# Altium schematic sheet fpga-tx.SchDoc
size D; CompanyName: Brinton Engineering, LLC; Address1: 3479 Edison Way; Address2: Menlo Park CA 94025; Address3: +1 (877) 778-8435; Address4: brintonengineering.com; DocumentNumber: 42; Revision: 1; SheetNumber: 42; SheetTotal: 50
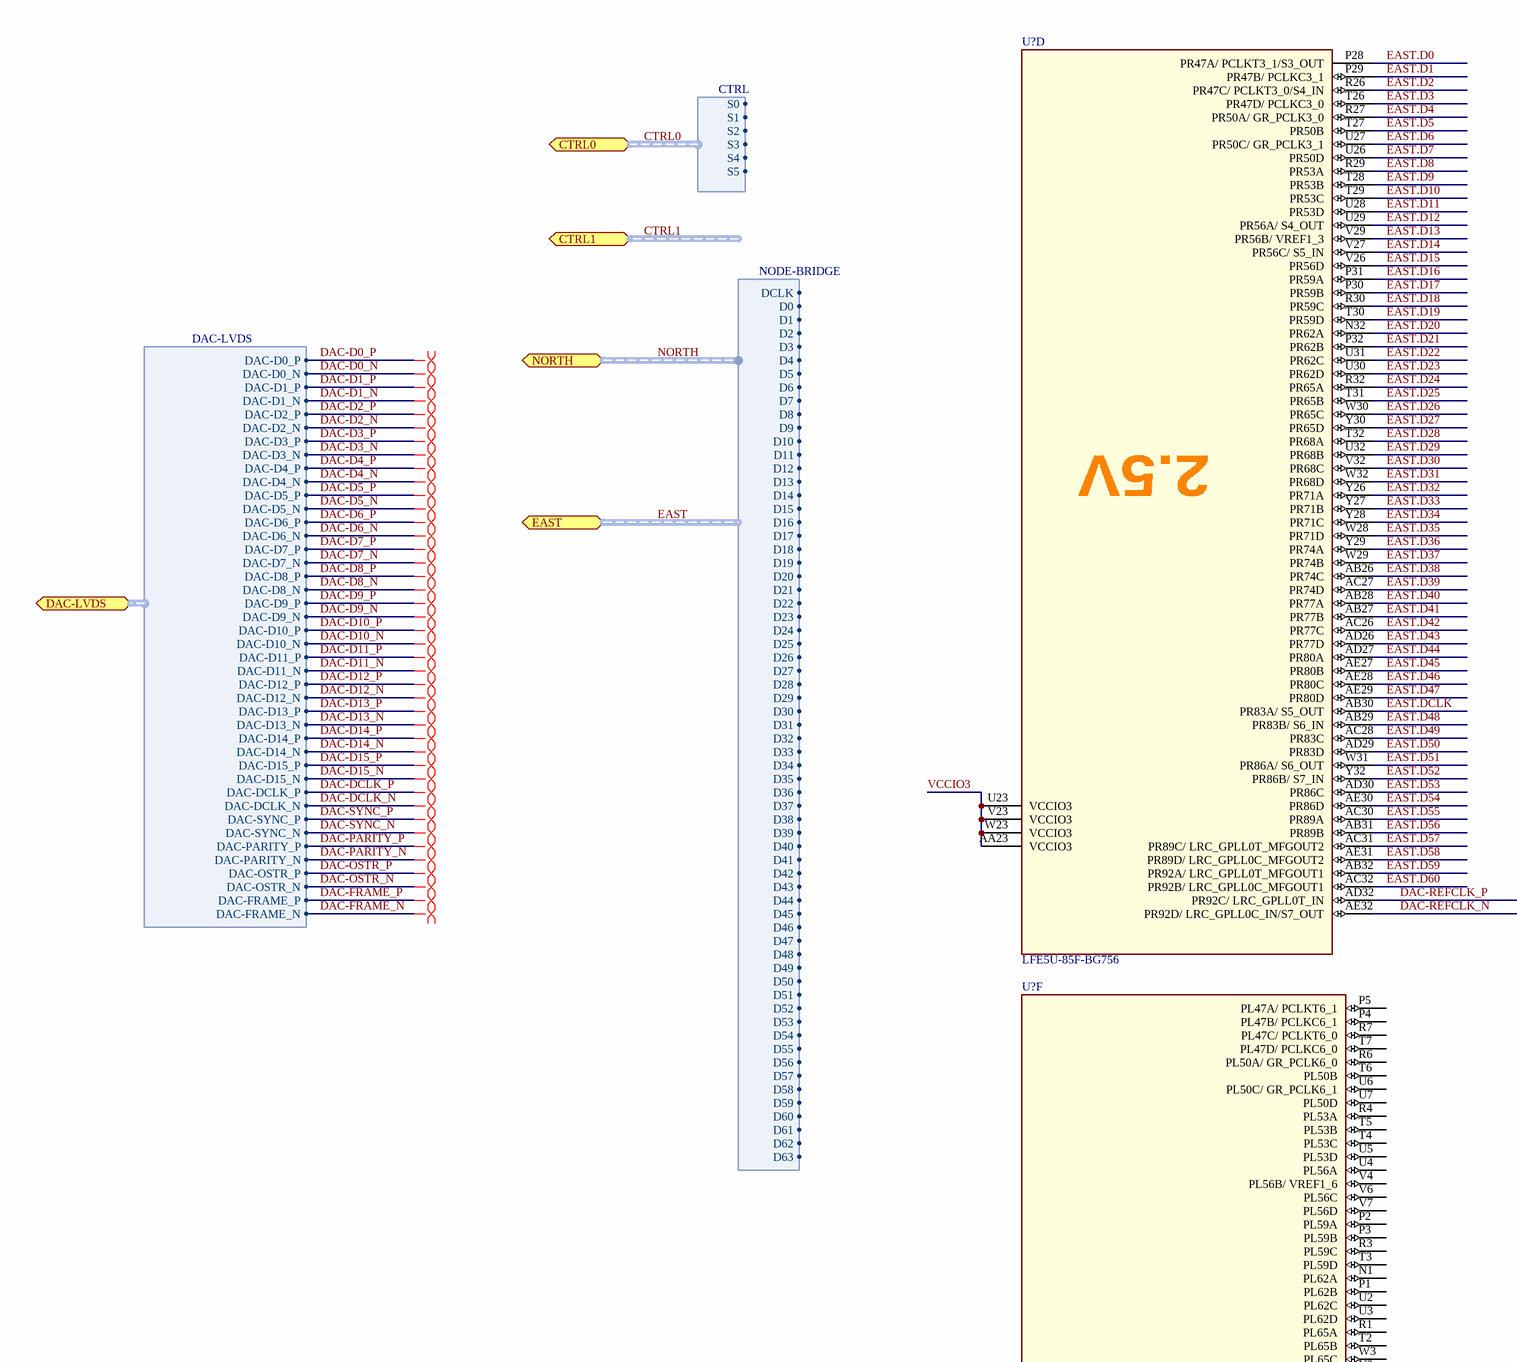
[diagram p0: fpga-tx.SchDoc, top left]
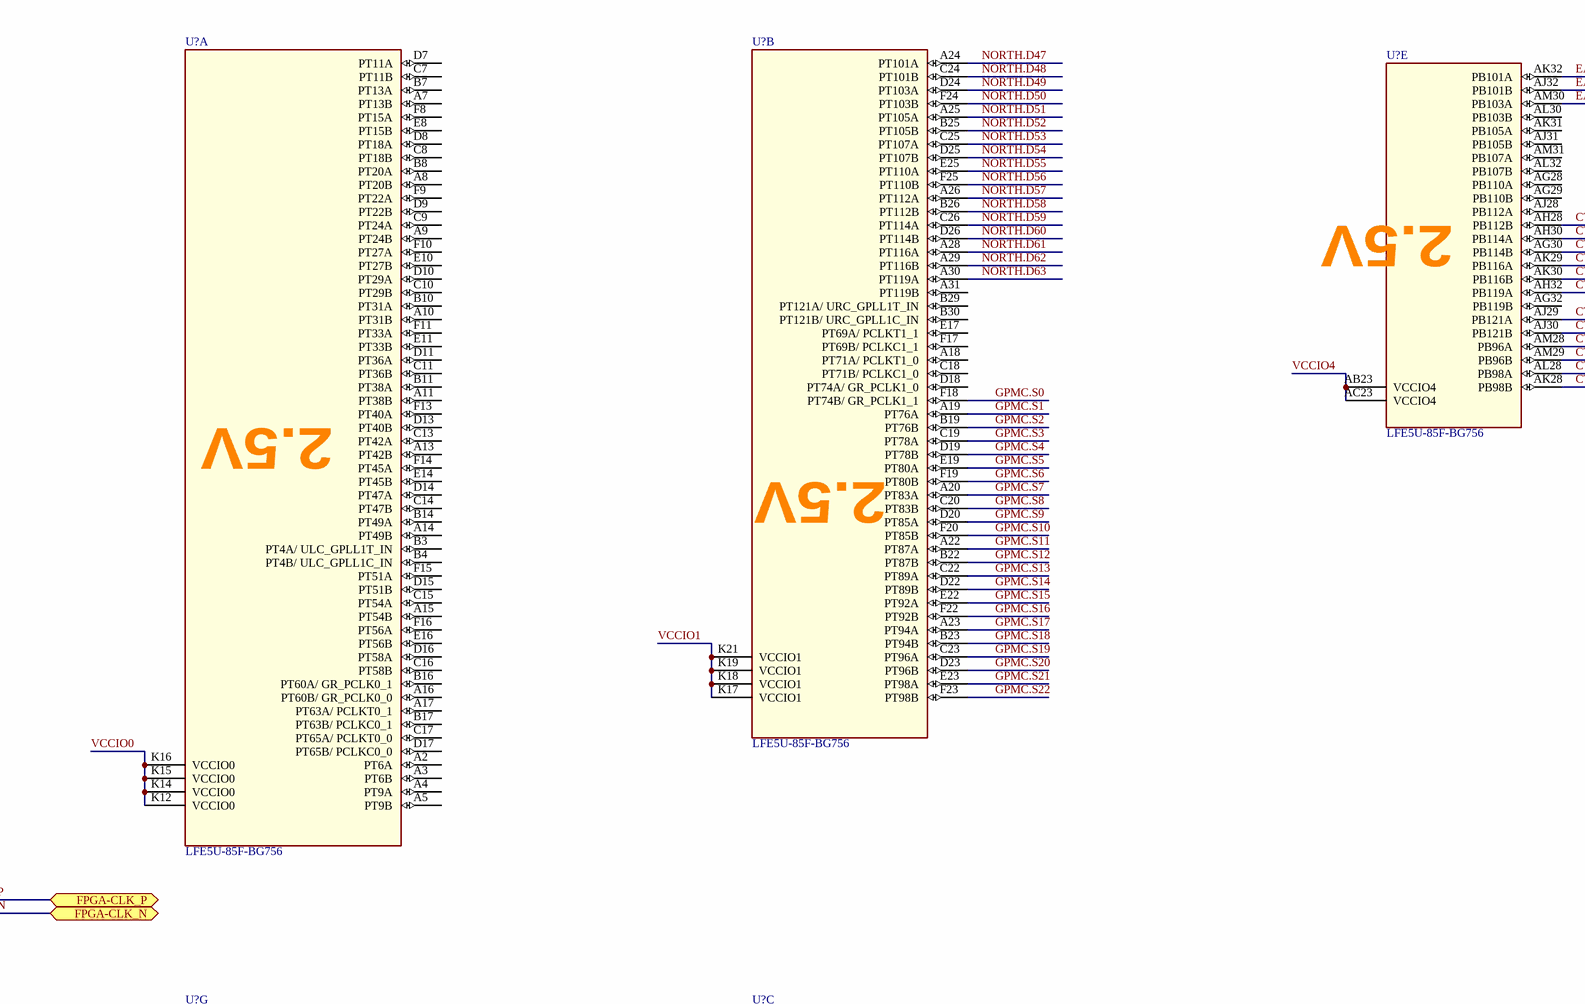
[diagram p1: fpga-tx.SchDoc, top middle]
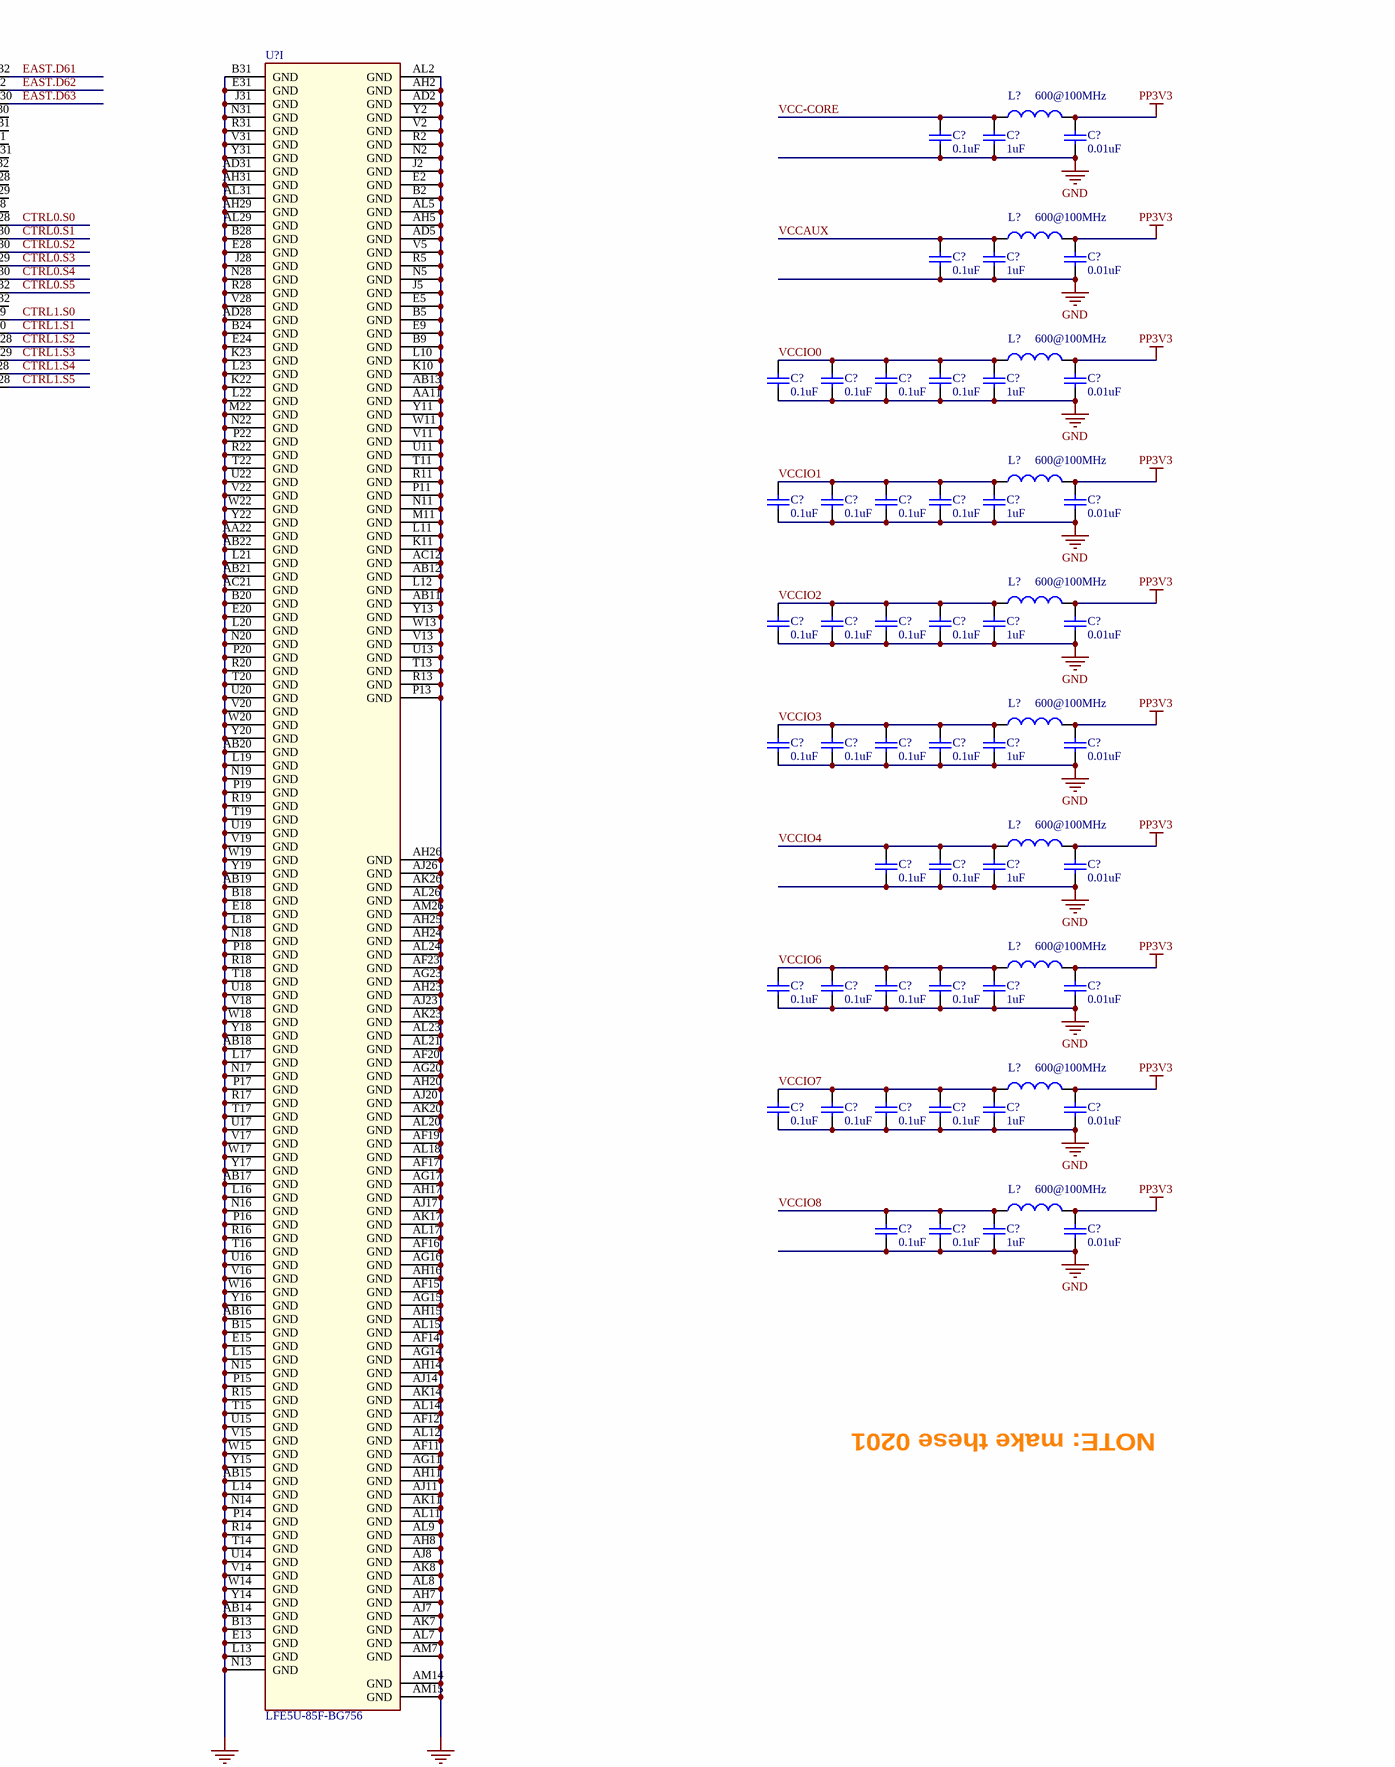
[diagram p2: fpga-tx.SchDoc, top right]
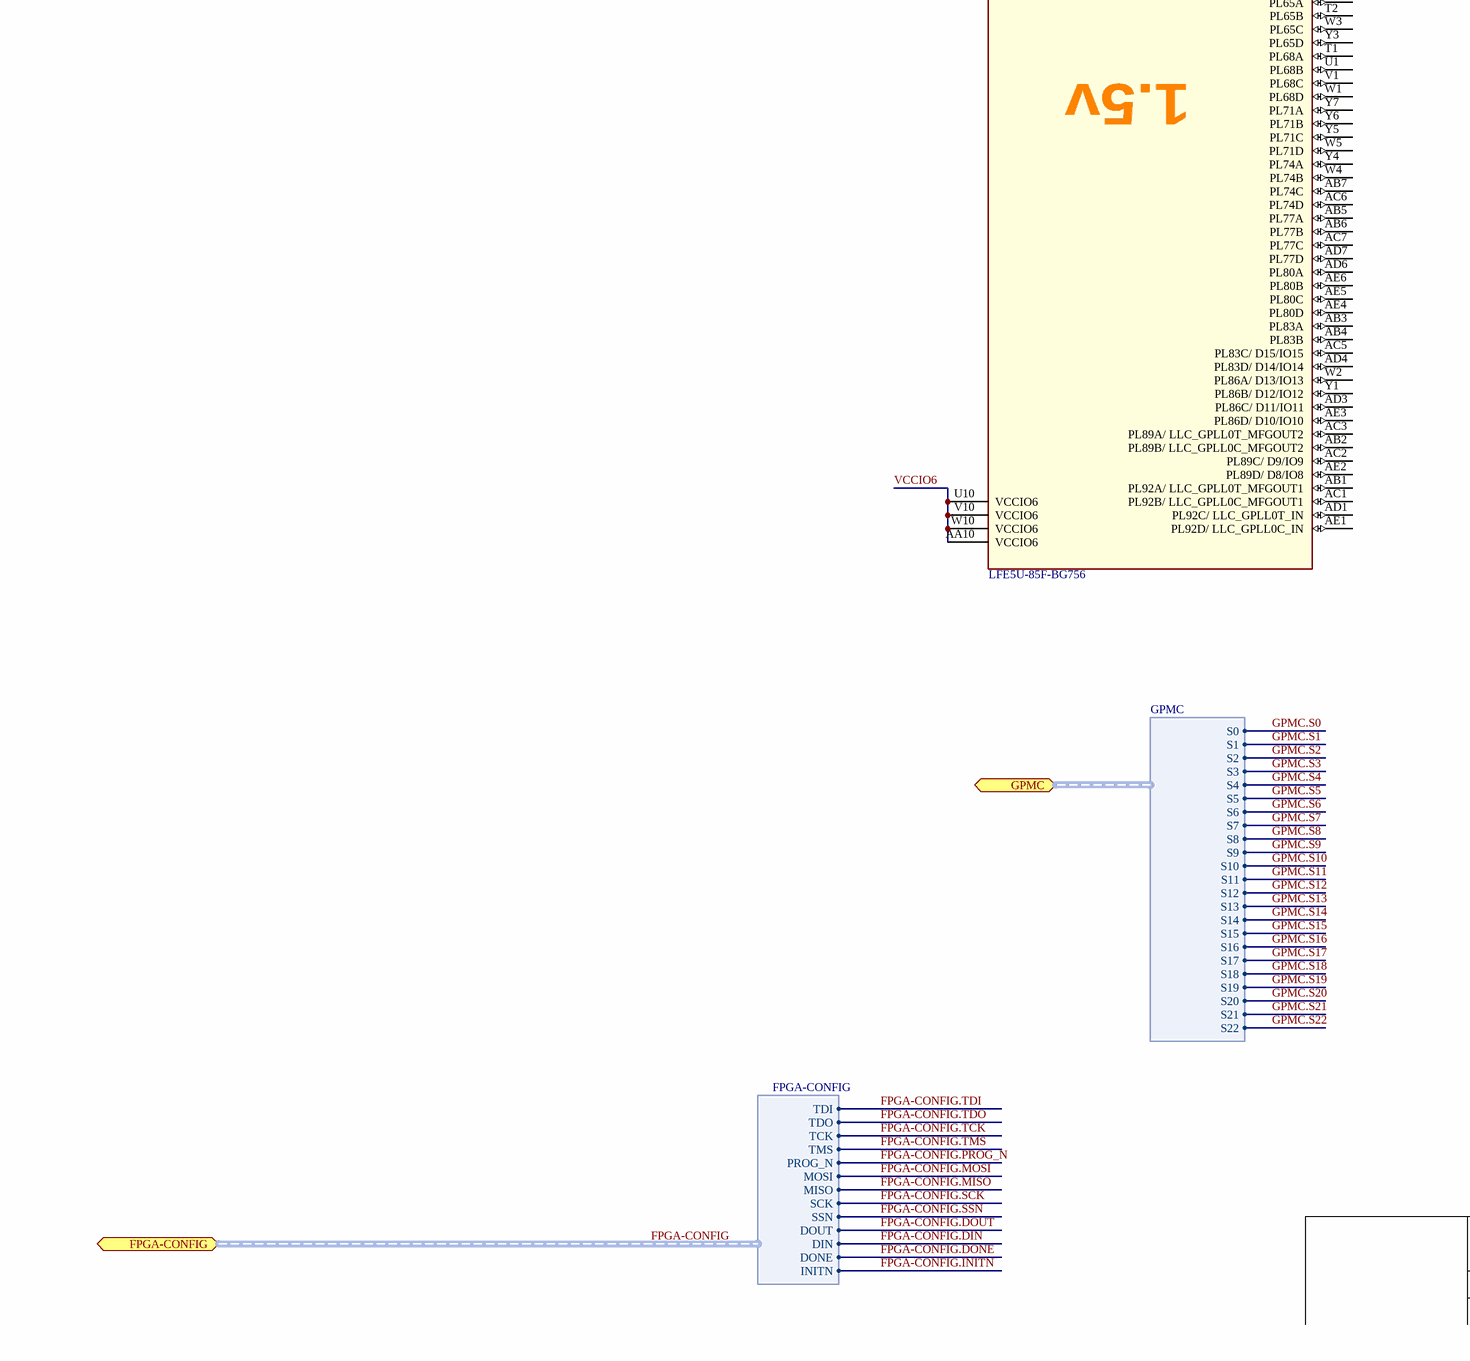
[diagram p3: fpga-tx.SchDoc, bottom left]
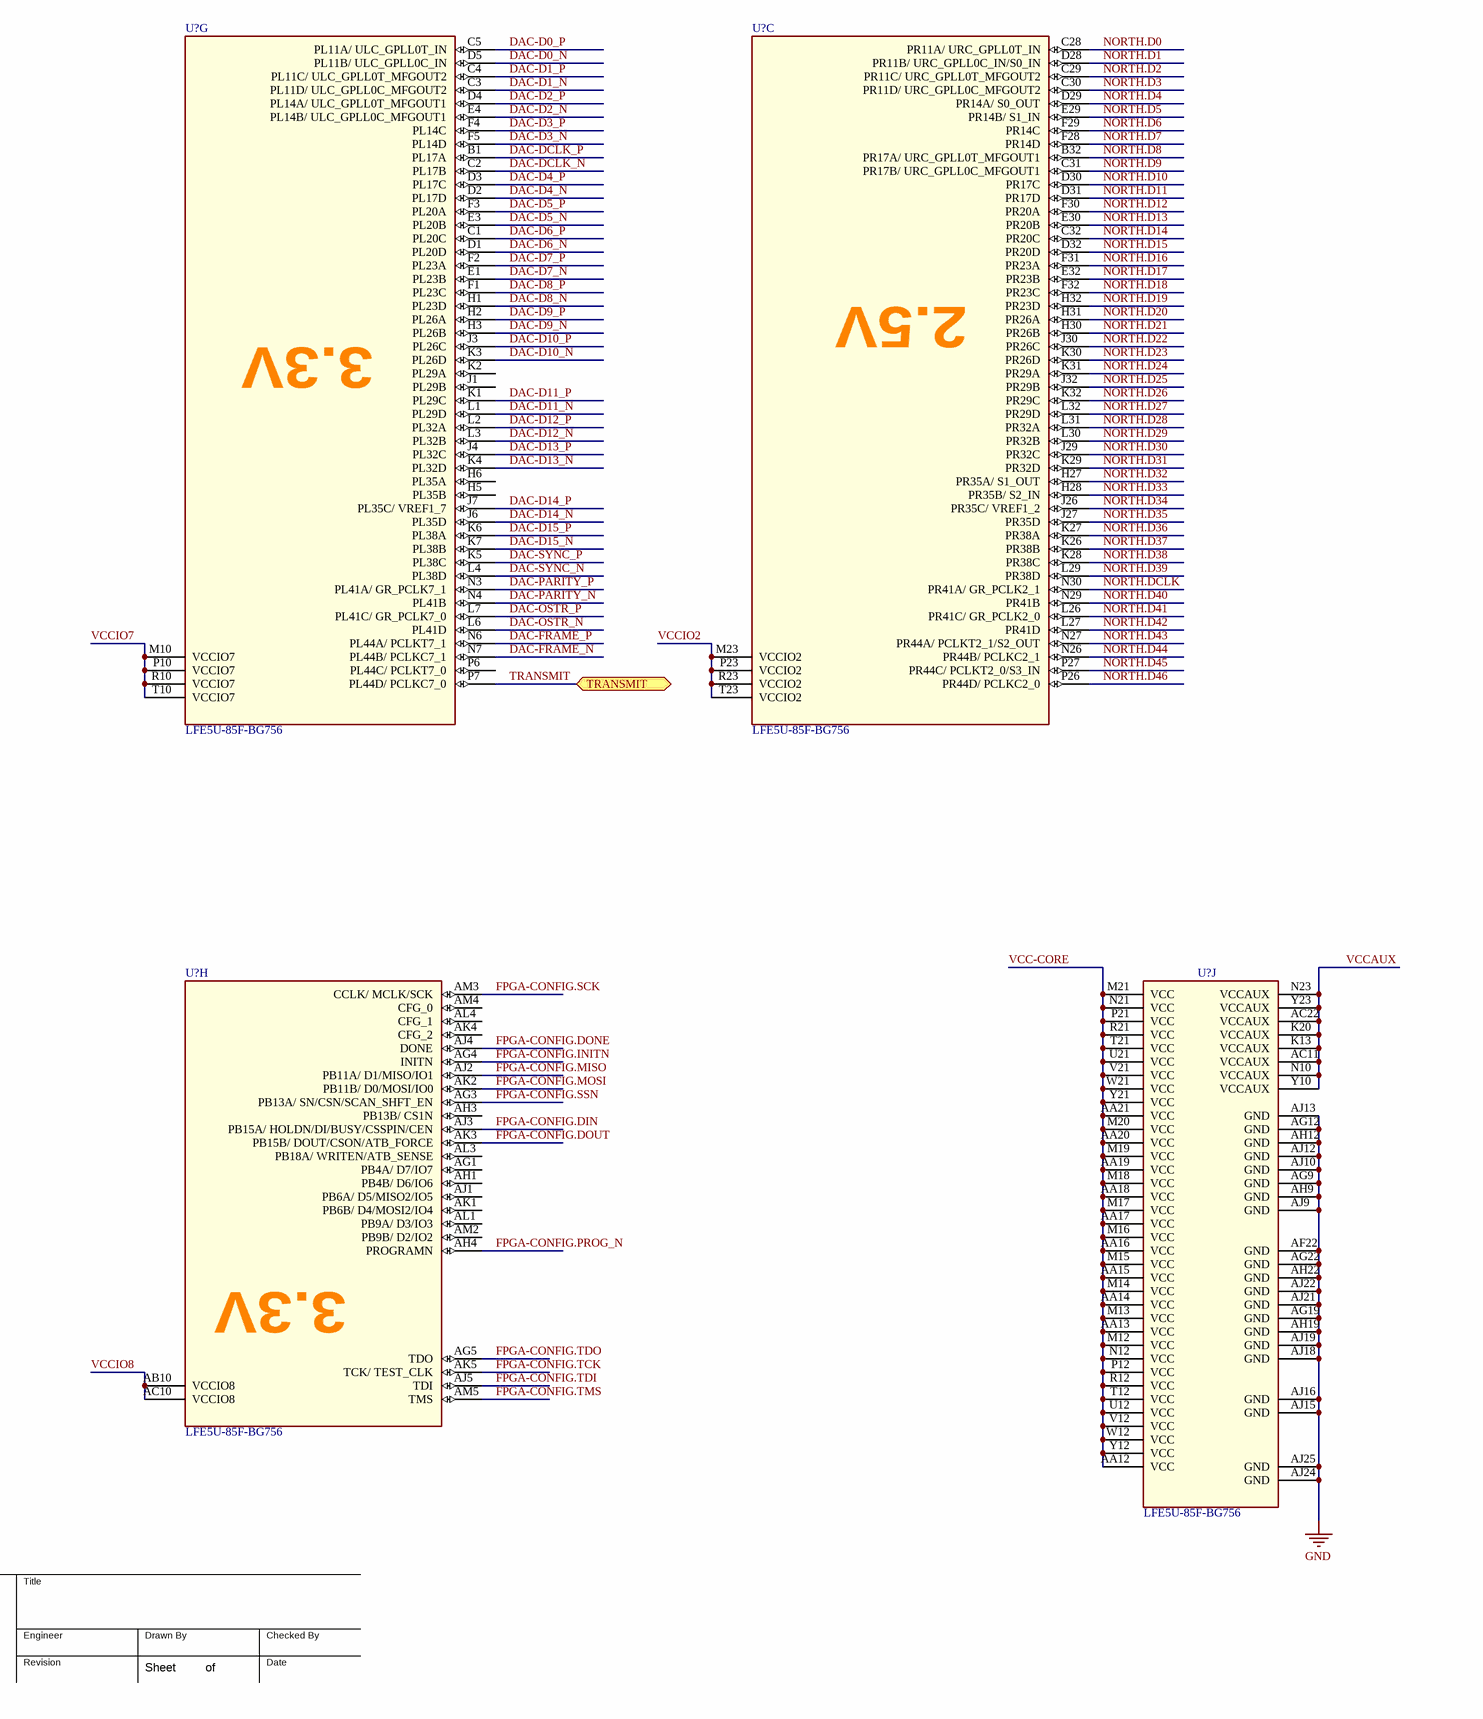
[diagram p4: fpga-tx.SchDoc, bottom middle]
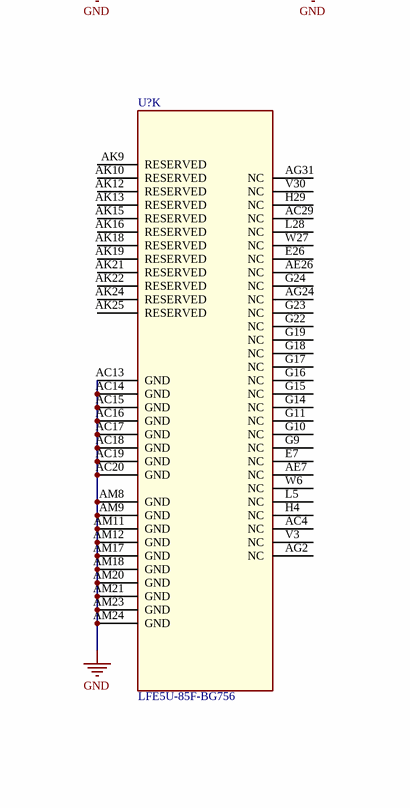
[diagram p5: fpga-tx.SchDoc, bottom right]

## Parts
(Parts that share a designator on the sheet are numbered #1, #2 ... from top to bottom, then left to right.)
C?#1  value 0.1uF  [0402]  (hidden comment: CAP 0402)
C?#2  value 1uF  [0402]  (hidden comment: CAP 0402)
C?#3  value 0.01uF  [0402]  (hidden comment: CAP 0402)
C?#4  value 0.1uF  [0402]  (hidden comment: CAP 0402)
C?#5  value 1uF  [0402]  (hidden comment: CAP 0402)
C?#6  value 0.01uF  [0402]  (hidden comment: CAP 0402)
C?#7  value 0.1uF  [0402]  (hidden comment: CAP 0402)
C?#8  value 0.1uF  [0402]  (hidden comment: CAP 0402)
C?#9  value 0.1uF  [0402]  (hidden comment: CAP 0402)
C?#10  value 0.1uF  [0402]  (hidden comment: CAP 0402)
C?#11  value 1uF  [0402]  (hidden comment: CAP 0402)
C?#12  value 0.01uF  [0402]  (hidden comment: CAP 0402)
C?#13  value 0.1uF  [0402]  (hidden comment: CAP 0402)
C?#14  value 0.1uF  [0402]  (hidden comment: CAP 0402)
C?#15  value 0.1uF  [0402]  (hidden comment: CAP 0402)
C?#16  value 0.1uF  [0402]  (hidden comment: CAP 0402)
C?#17  value 1uF  [0402]  (hidden comment: CAP 0402)
C?#18  value 0.01uF  [0402]  (hidden comment: CAP 0402)
C?#19  value 0.1uF  [0402]  (hidden comment: CAP 0402)
C?#20  value 0.1uF  [0402]  (hidden comment: CAP 0402)
C?#21  value 0.1uF  [0402]  (hidden comment: CAP 0402)
C?#22  value 0.1uF  [0402]  (hidden comment: CAP 0402)
C?#23  value 1uF  [0402]  (hidden comment: CAP 0402)
C?#24  value 0.01uF  [0402]  (hidden comment: CAP 0402)
C?#25  value 0.1uF  [0402]  (hidden comment: CAP 0402)
C?#26  value 0.1uF  [0402]  (hidden comment: CAP 0402)
C?#27  value 0.1uF  [0402]  (hidden comment: CAP 0402)
C?#28  value 0.1uF  [0402]  (hidden comment: CAP 0402)
C?#29  value 1uF  [0402]  (hidden comment: CAP 0402)
C?#30  value 0.01uF  [0402]  (hidden comment: CAP 0402)
C?#31  value 0.1uF  [0402]  (hidden comment: CAP 0402)
C?#32  value 0.1uF  [0402]  (hidden comment: CAP 0402)
C?#33  value 1uF  [0402]  (hidden comment: CAP 0402)
C?#34  value 0.01uF  [0402]  (hidden comment: CAP 0402)
C?#35  value 0.1uF  [0402]  (hidden comment: CAP 0402)
C?#36  value 0.1uF  [0402]  (hidden comment: CAP 0402)
C?#37  value 0.1uF  [0402]  (hidden comment: CAP 0402)
C?#38  value 0.1uF  [0402]  (hidden comment: CAP 0402)
C?#39  value 1uF  [0402]  (hidden comment: CAP 0402)
C?#40  value 0.01uF  [0402]  (hidden comment: CAP 0402)
C?#41  value 0.1uF  [0402]  (hidden comment: CAP 0402)
C?#42  value 0.1uF  [0402]  (hidden comment: CAP 0402)
C?#43  value 0.1uF  [0402]  (hidden comment: CAP 0402)
C?#44  value 0.1uF  [0402]  (hidden comment: CAP 0402)
C?#45  value 1uF  [0402]  (hidden comment: CAP 0402)